# EasyEDA Pro project 第十五届蓝桥杯EDA赛项模拟试题二（嘉立创EDA提供）.eprj, board PCB-PockerMultimater1
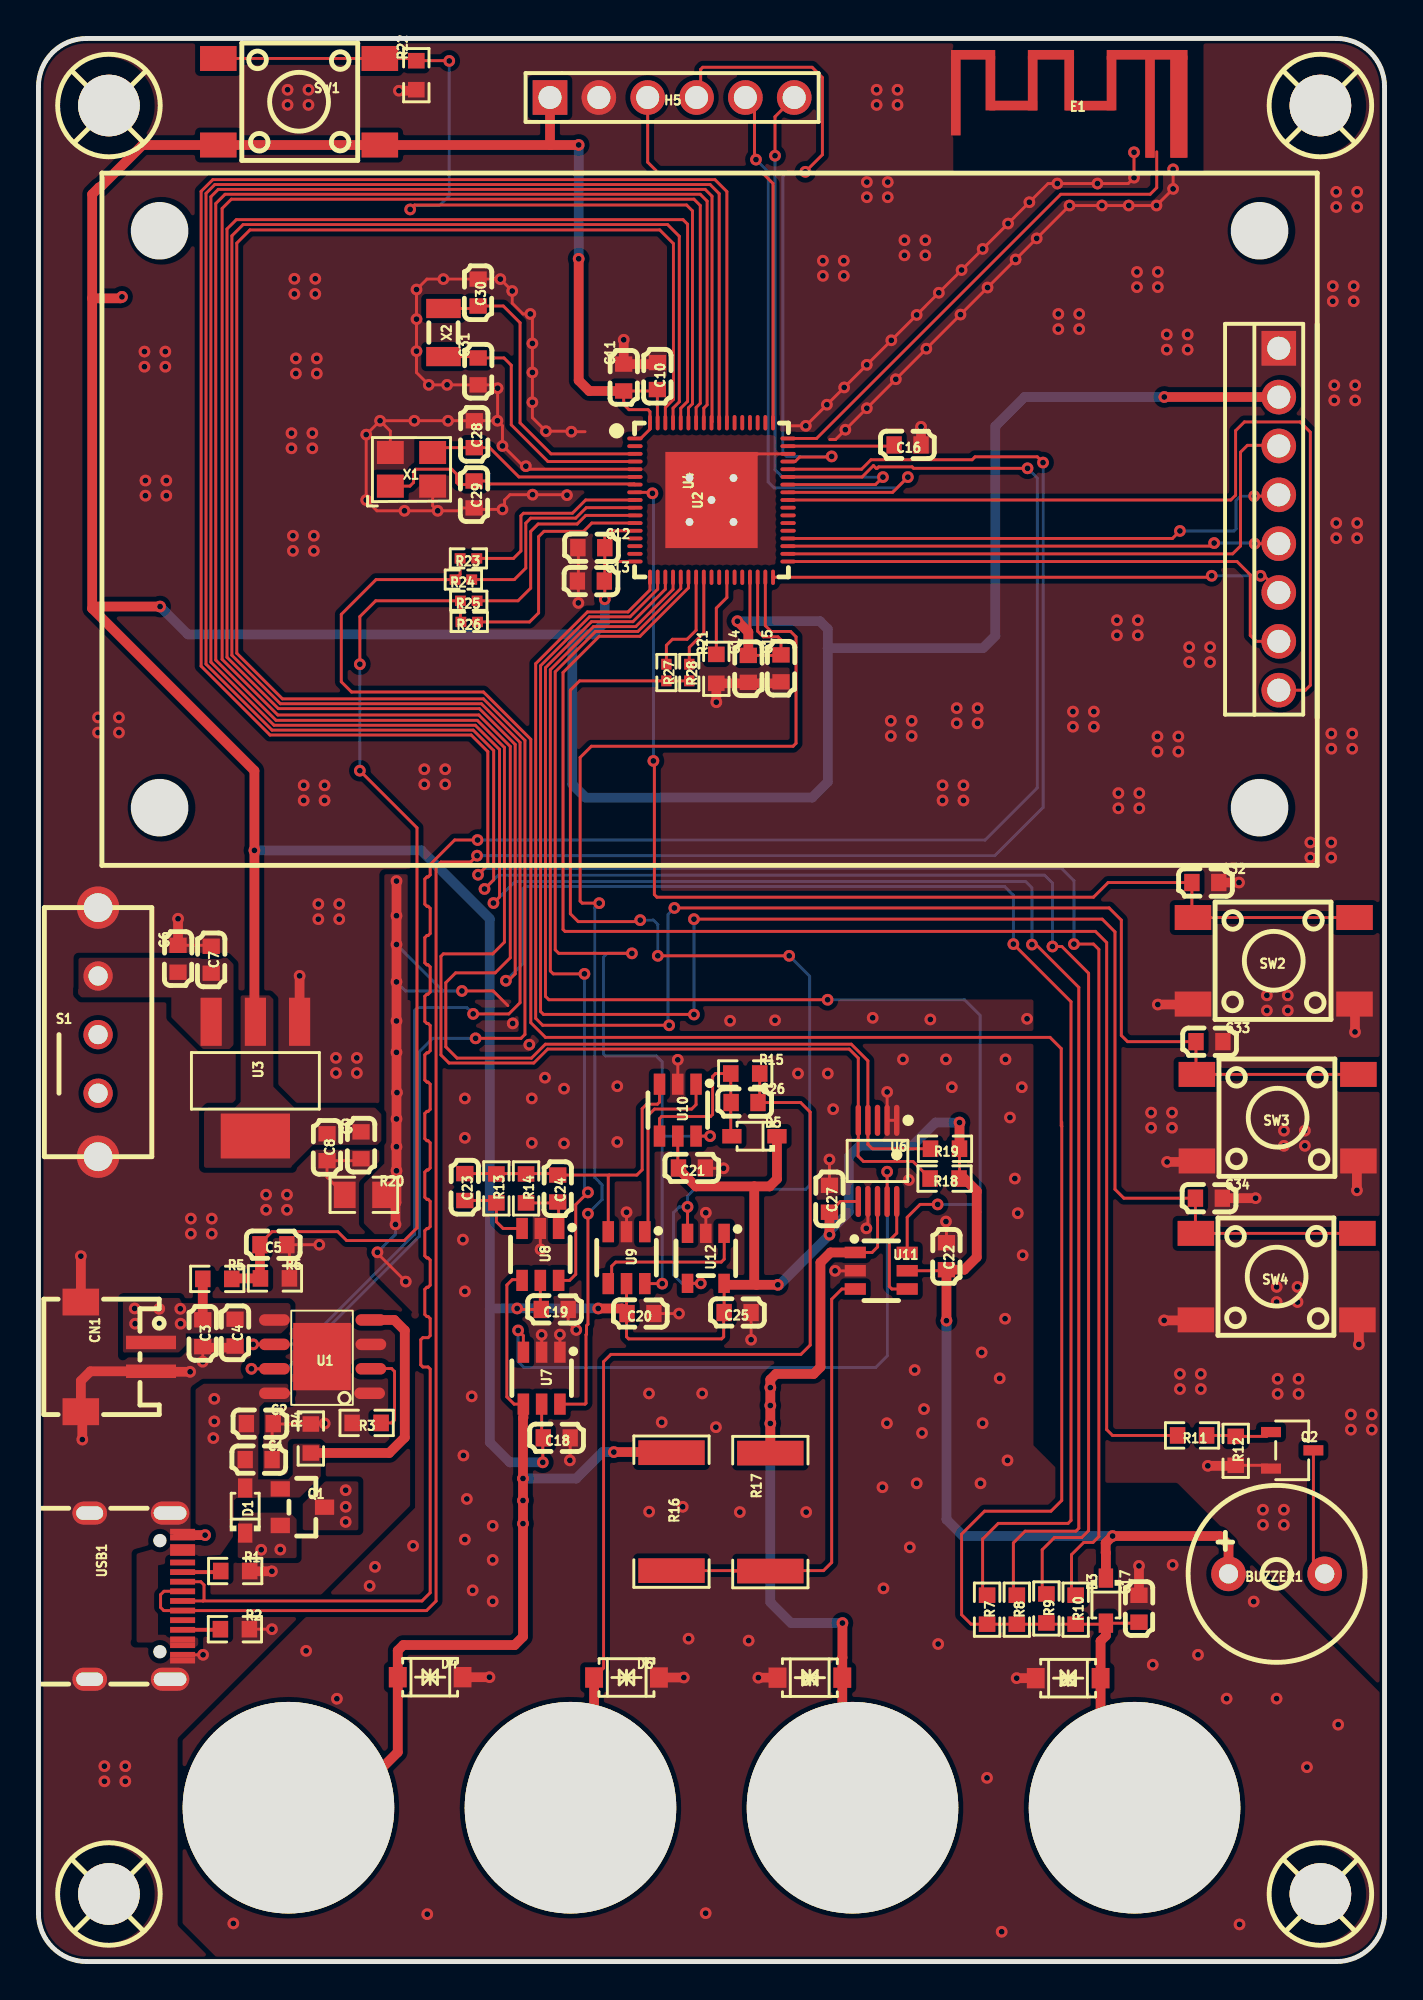
[diagram p1: board, top side]
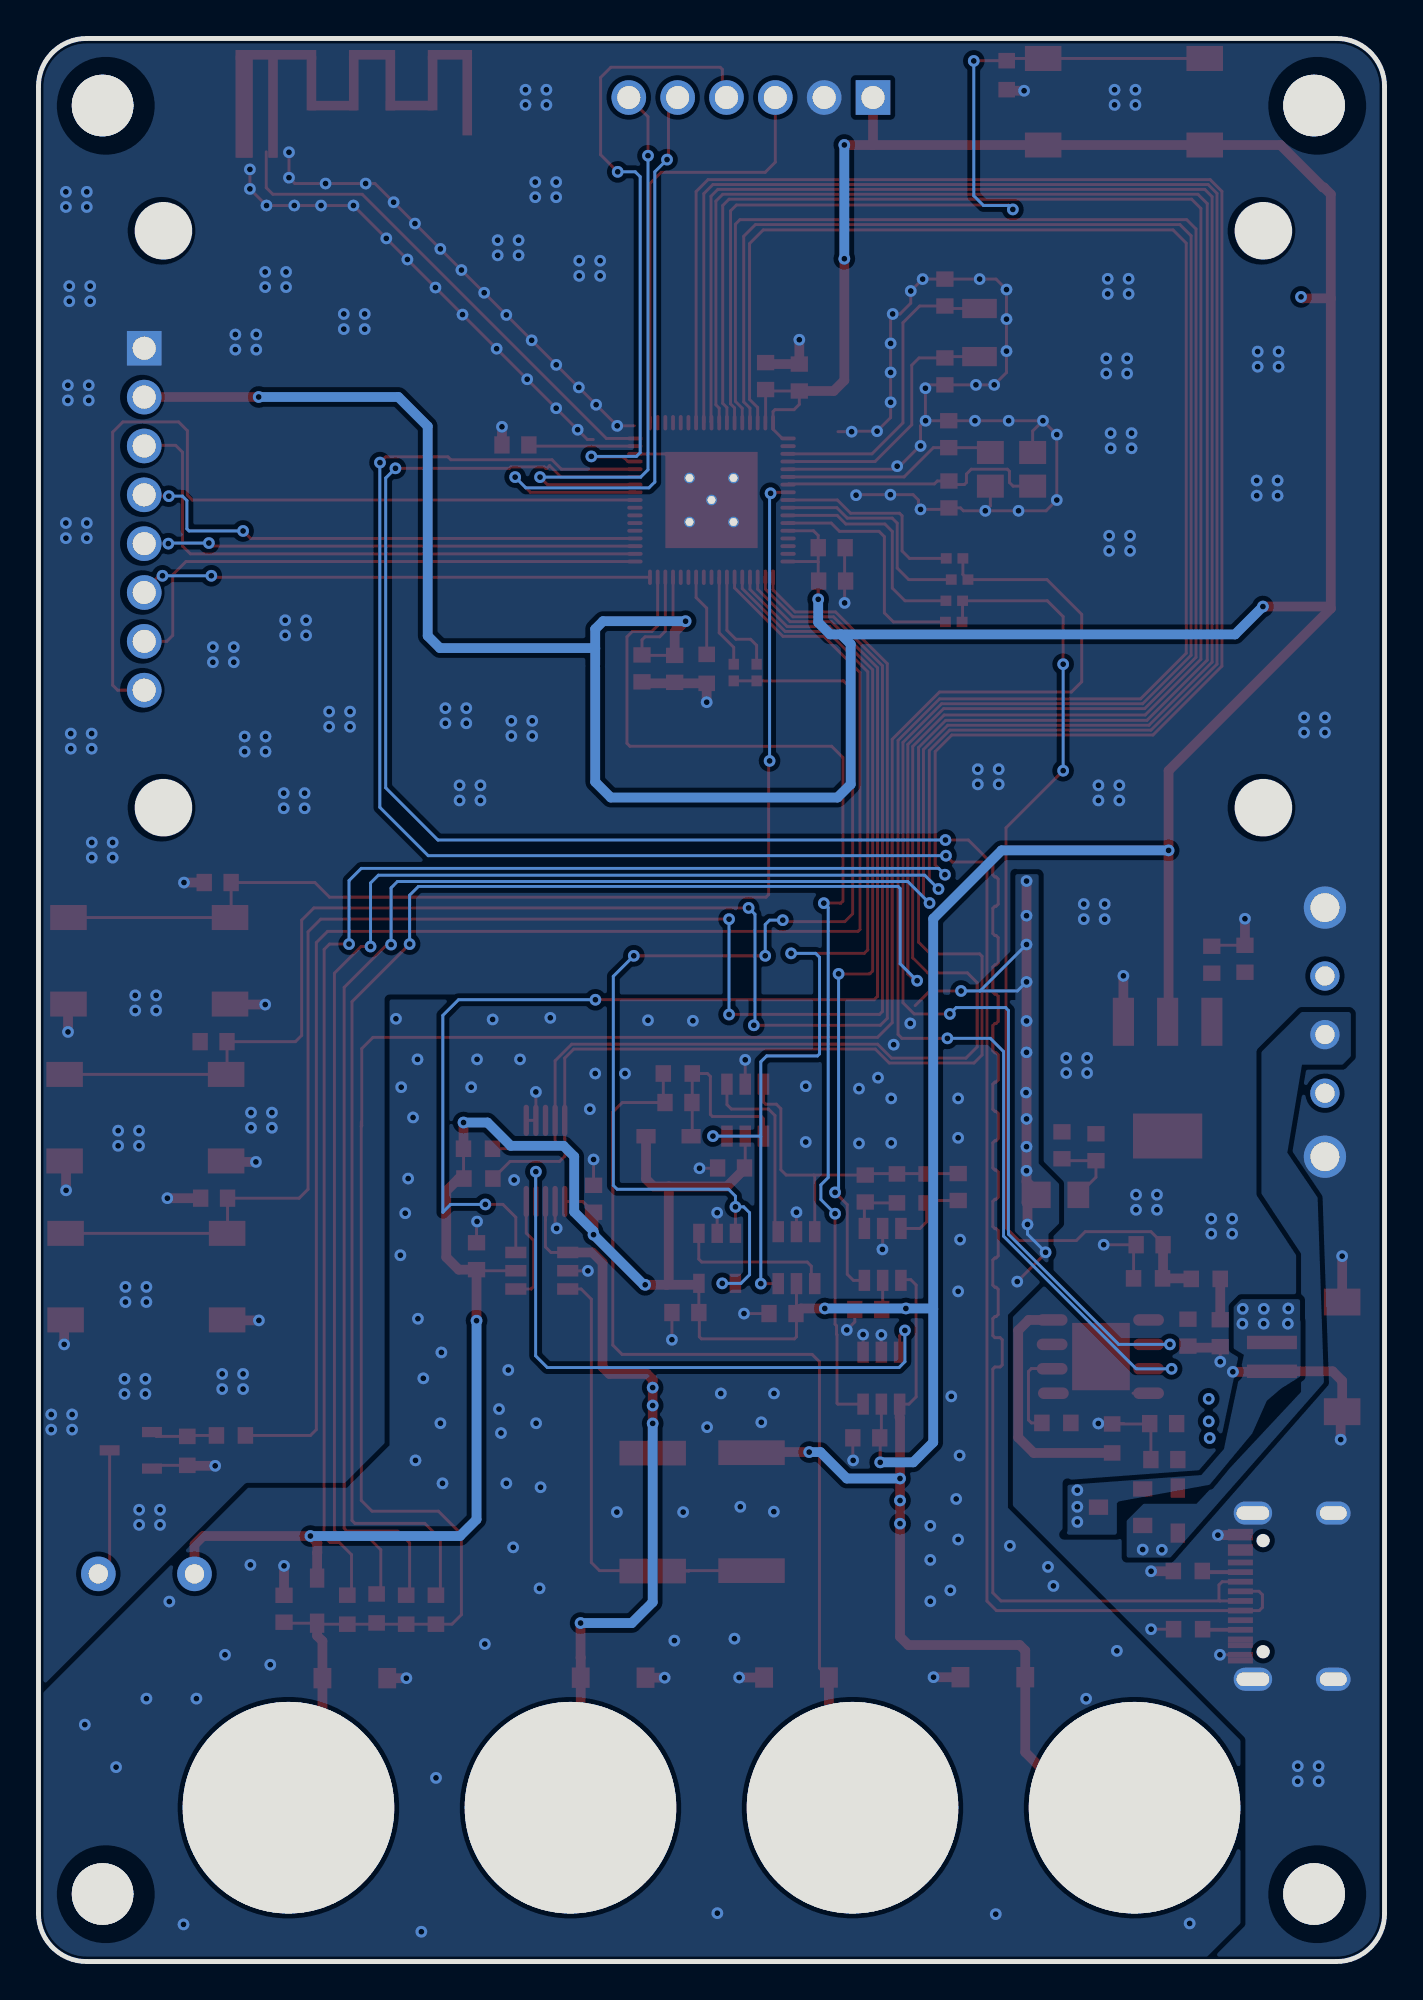
[diagram p2: board, bottom side, seen from below]

Outline 70 x 100 mm; copper layers: Top Layer, Bottom Layer. Coordinates in mm from the lower left corner of the outline.
Outline path: 0,97.5 0,2.5 arc(0.73,0.73) 2.5,0 67.5,0 arc(69.27,0.73) 70,2.5 70,97.5 arc(69.27,99.27) 67.5,100 2.5,100 arc(0.73,99.27) 0,97.5
Stack: Top Layer 0.035mm / Dielectric1 1.51mm FR4 er 4.5 / Bottom Layer 0.035mm

## Design rules (mm)
net USB1DP: DP1
net USB1DM: DP1
template: 自定义配置
spacing copperThickness1oz (default): track to track 0.102, other pairs 0.152 to 0.3
spacing copperThickness2oz: track to track 0.203, other pairs 0.152 to 0.3
spacing ANT: track to track 0.152, other pairs 0.152 to 0.152
track width copperThickness1oz (default): min 0.152, default 0.152, max 2.54
track width copperThickness2oz: min 0.203, default 0.254, max 2.54
differential pair differentialPair (default): width min 0.152, default 0.152, max 2.54; gap min 0.152, default 0.152
via viaSize (default): diameter min 0.559, default 0.559, max 10; hole min 0.254, default 0.254, max 6.299

## Placement (name value [footprint] x y rotation side)
BUZZER1  3kHz  [BUZ-TH_BD9.0-P5.00-D0.6-FD]  64.39 20.16 0 top
C1  10uF  [C0603]  11.45 26.1 180 top
C2  100nF  [C0603]  11.51 27.97 180 top
C3  10uF  [C0603]  8.54 32.67 90 top
C4  100nF  [C0603]  10.22 32.7 90 top
C5  100nF  [C0603]  12.22 37.27 0 top
C6  10uF  [C0603]  7.26 52.14 270 top
C7  100nF  [C0603]  8.98 52.09 90 top
C8  10uF  [C0603]  15.01 42.34 90 top
C9  100nF  [C0603]  16.77 42.44 270 top
C10  100nF  [C0603]  32.19 82.44 90 top
C11  100nF  [C0603]  30.43 82.37 270 top
C12  100nF  [C0603]  28.75 73.52 180 top
C13  100nF  [C0603]  28.73 71.79 180 top
C14  100nF  [C0603]  36.91 67.22 270 top
C15  100nF  [C0603]  38.61 67.24 270 top
C16  1uF  [C0603]  45.2 78.86 0 top
C17  100nF  [C0603]  57.23 18.35 270 top
C18  100nF  [C0603]  26.95 27.23 0 top
C19  100nF  [C0603]  26.85 33.91 0 top
C20  100nF  [C0603]  31.31 33.69 0 top
C21  100nF  [C0603]  33.98 41.27 0 top
C22  100nF  [C0603]  47.22 36.68 90 top
C23  100nF  [C0603]  22.17 40.27 90 top
C24  100nF  [C0603]  27 40.2 90 top
C25  100nF  [C0603]  36.36 33.75 0 top
C26  100nF  [C0603]  36.72 44.67 180 top
C27  100nF  [C0603]  41.13 39.66 90 top
C28  12pF  [C0603]  22.66 79.42 90 top
C29  12pF  [C0603]  22.65 76.29 90 top
C30  12pF  [C0603]  22.86 86.79 90 top
C31  12pF  [C0603]  22.86 82.69 270 top
C32  100nF  [C0603]  60.68 56.11 180 top
C33  100nF  [C0603]  60.89 47.83 180 top
C34  100nF  [C0603]  60.87 39.69 180 top
CN1  1.5K-BH-2PWB  [CONN-SMD_2P-P1.50_HDGC_1.5K-BH-2PWB]  4.03 31.44 270 top
D1  1N5819WS  [SOD-323_L1.8-W1.3-LS2.5-RD]  10.75 23.45 90 top
D2  SJD12C40L01  [SOD-123_L2.8-W1.8-LS3.7-BI]  53.55 14.74 0 top
D3  1N4148  [SOD-323_L1.8-W1.3-LS2.5-RD]  55.51 18.77 270 top
D4  SJD12C40L01  [SOD-123_L2.8-W1.8-LS3.7-BI]  20.37 14.79 180 top
D5  1N4148  [SOD-323_L1.8-W1.3-LS2.5-RD]  37.23 42.92 180 top
D6  SJD12C40L01  [SOD-123_L2.8-W1.8-LS3.7-BI]  30.58 14.77 180 top
D7  SJD12C40L01  [SOD-123_L2.8-W1.8-LS3.7-BI]  40.12 14.76 0 top
E1  d62bb7b376ef4f1495932ffa50be4b9b  [ANT-F-1-2.4G-1.6]  58.15 94.1 0 top
H1  -  [M3]  3.5 96.5 0 top
H2  -  [M3]  66.5 96.5 0 top
H3  -  [M3]  3.5 3.5 0 top
H4  -  [M3]  66.5 3.5 0 top
H5  2.54-1x6P直针  [HDR-TH_6P-P2.54-V-M-1]  32.95 96.93 0 top
J1  -  [香蕉头-4mm-24.302.*]  13 8 0 top
J2  -  [香蕉头-4mm-24.302.*]  27.67 8 0 top
J3  -  [香蕉头-4mm-24.302.*]  42.33 8 0 top
J4  -  [香蕉头-4mm-24.302.*]  57 8 0 top
Q1  AO3401A  [SOT-23_L2.9-W1.3-P1.90-LS2.4-BR]  13.73 23.63 180 top
Q2  S8050  [SOT-23-3_L3.0-W1.7-P0.95-LS2.9-BR]  65.2 26.58 180 top
R1  5.1kΩ  [R0603]  10.23 20.31 180 top
R2  5.1kΩ  [R0603]  10.22 17.28 180 top
R3  10kΩ  [R0603]  17.07 28.01 0 top
R4  10kΩ  [R0603]  14.17 27.2 270 top
R5  10kΩ  [R0603]  9.3 35.5 180 top
R6  10kΩ  [R0603]  12.3 35.52 180 top
R7  1kΩ  [R0603]  49.33 18.3 90 top
R8  10kΩ  [R0603]  50.88 18.3 90 top
R9  100kΩ  [R0603]  52.42 18.36 90 top
R10  1MΩ  [R0603]  53.94 18.3 90 top
R11  10kΩ  [R0603]  59.99 27.36 0 top
R12  10kΩ  [R0603]  62.26 26.56 90 top
R13  100kΩ  [R0603]  23.81 40.2 90 top
R14  1MΩ  [R0603]  25.36 40.2 90 top
R15  1MΩ  [R0603]  36.75 46.18 180 top
R16  10mΩ  [R2512]  32.92 23.39 90 top
R17  80mΩ  [R2512]  38.06 23.37 270 top
R18  4.7kΩ  [R0603]  47.12 40.72 0 top
R19  4.7kΩ  [R0603]  47.14 42.27 0 top
R20  0Ω  [R0805]  16.92 39.87 180 top
R21  10kΩ  [R0603]  35.25 67.22 270 top
R22  10kΩ  [R0603]  19.65 98.09 270 top
R23  0Ω  [R0402]  22.36 72.96 0 top
R24  0Ω  [R0402]  22.1 71.86 0 top
R25  0Ω  [R0402]  22.38 70.76 0 top
R26  0Ω  [R0402]  22.4 69.66 0 top
R27  0Ω  [R0402]  32.65 67.03 90 top
R28  0Ω  [R0402]  33.84 67.03 90 top
S1  SK-12E12-G5  [SW-TH_SK-12E12-G5]  3.1 48.33 180 top
SW1  TS-1002S-07026C  [KEY-SMD_4P-L6.0-W6.0-P4.50-LS9.0]  13.55 96.71 180 top
SW2  TS-1002S-07026C  [KEY-SMD_4P-L6.0-W6.0-P4.50-LS9.0]  64.24 52.04 0 top
SW3  TS-1002S-07026C  [KEY-SMD_4P-L6.0-W6.0-P4.50-LS9.0]  64.44 43.88 0 top
SW4  TS-1002S-07026C  [KEY-SMD_4P-L6.0-W6.0-P4.50-LS9.0]  64.39 35.61 0 top
U1  TP4056X-42-ESOP8  [TP4056-SOP8]  14.75 31.46 0 top
U2  -  [2.0寸TFT屏幕模块-8Pin]  35 75 270 top
U3  AMS1117-3.3  [SOT-223-3_L6.5-W3.4-P2.30-LS7.0-BR]  11.28 45.9 90 top
U4  7693da239a7c4f18baa0651e8e27e4a9  [QFN68(8x8)]  35 76 270 top
U6  INA226AIDGSR  [MSOP-10_L3.0-W3.0-P0.50-LS5.0-BL]  43.63 41.63 180 top
U7  SN74LVC1G3157DBVR  [SOT-23-6_L2.9-W1.6-P0.95-LS2.8-BR]  26.17 30.33 90 top
U8  SN74LVC1G3157DBVR  [SOT-23-6_L2.9-W1.6-P0.95-LS2.8-BR]  26.1 36.77 90 top
U9  SN74LVC1G3157DBVR  [SOT-23-6_L2.9-W1.6-P0.95-LS2.8-BR]  30.58 36.6 90 top
U10  SN74LVC1G3157DBVR  [SOT-23-6_L2.9-W1.6-P0.95-LS2.8-BR]  33.25 44.27 90 top
U11  SN74LVC1G3157DBVR  [SOT-23-6_L2.9-W1.6-P0.95-LS2.8-BR]  43.83 35.92 180 top
U12  LMV321IDBVR  [SOT-23-5_L3.0-W1.7-P0.95-LS2.8-BR]  34.7 36.57 90 top
USB1  KH-TYPE-C-16P  [USB-C-SMD_KH-TYPE-C-16P]  5.08 19 270 top
X1  32MHz  [OSC-SMD_4P-L3.2-W2.5-BL]  19.4 77.59 0 top
X2  32.768kHz  [FC-135R_L3.2-W1.5]  21.06 84.71 90 top

## Footprints (pads in the part's own frame, mm; a bottom-side part is the same pattern mirrored in y, then rotated)
2.0寸TFT屏幕模块-8Pin
  rect 1.8x1.8 hole 1.2: 1(-8.89,29.5)
  round 1.8 hole 1.2: 2(-6.35,29.5) 3(-3.81,29.5) 4(-1.27,29.5) 5(1.27,29.5) 6(3.81,29.5) 7(6.35,29.5) 8(8.89,29.5)
ANT-F-1-2.4G-1.6
  rect 0.8x0.6 smd: 0(1.143,0)
  rect 0.4x0.6 smd: 1(-0.34,0)
BUZ-TH_BD9.0-P5.00-D0.6-FD
  round 1.8 hole 1: 1(-2.5,0) 2(2.5,0)
C0603
  rect 0.8x0.9 smd: 1(-0.7,0) 2(0.7,0)
CONN-SMD_2P-P1.50_HDGC_1.5K-BH-2PWB
  rect 0.7x2.6 smd: 1(-0.75,1.825) 2(0.75,1.825)
  rect 1.4x1.9 smd: 3(2.85,-1.825) 4(-2.85,-1.825)
FC-135R_L3.2-W1.5
  rect 1x1.8 smd: 1(-1.25,0) 2(1.25,0)
HDR-TH_6P-P2.54-V-M-1
  rect 1.8x1.8 hole 1.2: 1(-6.35,0)
  round 1.8 hole 1.2: 2(-3.81,0) 3(-1.27,0) 4(1.27,0) 5(3.81,0) 6(6.35,0)
KEY-SMD_4P-L6.0-W6.0-P4.50-LS9.0
  rect 1.9x1.3 smd: 1(-4.2,2.25) 2(4.2,2.25) 3(-4.2,-2.25) 4(4.2,-2.25)
M3
  round 3.2 hole 3.2: 0(0.165,0.013)
MSOP-10_L3.0-W3.0-P0.50-LS5.0-BL
  oval 0.28x1.62 smd: 1(-1,-2.11) 2(-0.5,-2.11) 3(0,-2.11) 4(0.5,-2.11) 5(1,-2.11) 6(1,2.11) 7(0.5,2.11) 8(0,2.11) 9(-0.5,2.11) 10(-1,2.11)
OSC-SMD_4P-L3.2-W2.5-BL
  rect 1.4x1.2 smd: 1(-1.1,-0.875) 2(1.1,-0.875) 3(1.1,0.875) 4(-1.1,0.875)
QFN68(8x8)
  round 0.559 hole 0.406: 0(-1.143,1.143) 0(-1.143,-1.143) 0(0,0) 0(1.143,1.143) 0(1.143,-1.143)
  rect 5x4.8 smd: 0(0,0)
  oval 0.2x0.8 smd: 1(-3.2,-3.982) 2(-2.8,-3.982) 3(-2.4,-3.982) 4(-2,-3.982) 5(-1.6,-3.982) 6(-1.2,-3.982) 7(-0.8,-3.982) 8(-0.4,-3.982) 9(0,-3.982) 10(0.4,-3.982) 11(0.8,-3.982) 12(1.2,-3.982) 13(1.6,-3.982) 14(2,-3.982) 15(2.4,-3.982) 16(2.8,-3.982) 17(3.2,-3.982) 35(3.2,3.982) 36(2.8,3.982) 37(2.4,3.982) 38(2,3.982) 39(1.6,3.982) 40(1.2,3.982) 41(0.8,3.982) 42(0.4,3.982) 43(0,3.982) 44(-0.4,3.982) 45(-0.8,3.982) 46(-1.2,3.982) 47(-1.6,3.982) 48(-2,3.982) 49(-2.4,3.982) 50(-2.8,3.982) 51(-3.2,3.982)
  oval 0.8x0.2 smd: 18(4.018,-3.2) 19(4.018,-2.8) 20(4.018,-2.4) 21(4.018,-2) 22(4.018,-1.6) 23(4.018,-1.2) 24(4.018,-0.8) 25(4.018,-0.4) 26(4.018,0) 27(4.018,0.4) 28(4.018,0.8) 29(4.018,1.2) 30(4.018,1.6) 31(4.018,2) 32(4.018,2.4) 33(4.018,2.8) 34(4.018,3.2) 52(-4.018,3.2) 53(-4.018,2.8) 54(-4.018,2.4) 55(-4.018,2) 56(-4.018,1.6) 57(-4.018,1.2) 58(-4.018,0.8) 59(-4.018,0.4) 60(-4.018,0) 61(-4.018,-0.4) 62(-4.018,-0.8) 63(-4.018,-1.2) 64(-4.018,-1.6) 65(-4.018,-2) 66(-4.018,-2.4) 67(-4.018,-2.8) 68(-4.018,-3.2)
R0402
  rect 0.566x0.54 smd: 1(-0.433,0) 2(0.433,0)
R0603
  rect 0.806x0.864 smd: 1(-0.753,0) 2(0.753,0)
R0805
  rect 1.133x1.377 smd: 1(-1,0) 2(1,0)
R2512
  rect 1.282x3.456 smd: 1(-3.067,0) 2(3.067,0)
SOD-123_L2.8-W1.8-LS3.7-BI
  rect 0.93x1.06 smd: 1(1.685,0) 2(-1.685,0)
SOD-323_L1.8-W1.3-LS2.5-RD
  rect 1x0.75 smd: 1(-1.173,0) 2(1.173,0)
SOT-23-3_L3.0-W1.7-P0.95-LS2.9-BR
  rect 1.038x0.532 smd: 1(1.101,-0.95) 2(1.101,0.95) 3(-1.101,0)
SOT-23-5_L3.0-W1.7-P0.95-LS2.8-BR
  rect 1x0.6 smd: 1(1.3,-0.95) 2(1.3,0) 3(1.3,0.95) 4(-1.3,0.95) 5(-1.3,-0.95)
SOT-23-6_L2.9-W1.6-P0.95-LS2.8-BR
  rect 1.1x0.6 smd: 1(1.35,-0.95) 2(1.35,0) 3(1.35,0.95) 4(-1.35,0.95) 5(-1.35,0) 6(-1.35,-0.95)
SOT-23_L2.9-W1.3-P1.90-LS2.4-BR
  rect 1x0.8 smd: 1(1.15,-0.95) 2(1.15,0.95) 3(-1.15,0)
SOT-223-3_L6.5-W3.4-P2.30-LS7.0-BR
  rect 2.5x1.1 smd: 1(2.97,-2.3) 2(2.97,0) 3(2.97,2.3)
  rect 2.34x3.6 smd: 4(-2.97,0)
SW-TH_SK-12E12-G5
  round 1.524 hole 1: 1(0,3.175) 2(0,0.127) 3(0,-2.921)
  round 2.2 hole 1.5: 4(0,-6.477) 5(0,6.477)
TP4056-SOP8
  oval 1.6x0.6 smd: 1(2.475,-1.905) 2(2.54,-0.635) 3(2.54,0.635) 4(2.54,1.905) 5(-2.475,1.905) 6(-2.475,0.635) 7(-2.475,-0.635) 8(-2.475,-1.905)
  rect 3x3.5 smd: 9(0,0)
USB-C-SMD_KH-TYPE-C-16P
  oval 1.2x2 hole 0.7x1.7: 1(-4.32,1.765) 2(4.32,1.765)
  oval 1.2x1.8 hole 0.7x1.4: 3(-4.32,-2.415) 4(4.32,-2.415)
  rect 0.3x1.3 smd: A1(-3.35,2.415) A4(-2.55,2.415) A5(-1.25,2.415) A6(-0.25,2.415) A7(0.25,2.415) A8(1.25,2.415) A9(2.55,2.415) A12(3.35,2.415) B1(3.05,2.415) B4(2.25,2.415) B5(1.75,2.415) B6(0.75,2.415) B7(-0.75,2.415) B8(-1.75,2.415) B9(-2.25,2.415) B12(-3.05,2.415)
香蕉头-4mm-24.302.*
  round 11 hole 12.2x6.1: 1(0,0)

## Nets
As in the schematic.

Pads without a net: E1 0; H1 0; H2 0; H3 0; H4 0; S1 1; U4 2 14 15 16 26 27 29 30 39 40 41 42 53 54 55 56 57; U6 3; USB1 A8 B8

## Via types
v1: diameter 0.61, hole 0.305, Top Layer to Bottom Layer, 469 vias

## Routing (per net, layer and track width the routed paths; a pad name or vN(x,y) marks a point on that pad's centre or on a via; arc(x,y) is an arc through that point)
3V3: length 364.3
  Top Layer w0.152: 29.45,72.78 C12.1 29.45,74.16 29.7,74.4 U4.13 ; 29.45,72.78 v1(29.45,70.84) ; 29.45,72.78 29.47,72.8 U4.17 ; U4.32 37.4,69.18 37.69,68.89 38.46,68.89 38.61,68.73 C15.1 38.59,67.92 C14.1 37,68 U4.31 ; C20.1 30.58,33.67 30.58,32.49 30.69,32.38 35.53,32.38 35.63,32.49 35.63,33.72 C25.1 35.66,35.26 ; 30.58,33.85 U9.5 ; R19.2 47.9,40.74 R18.2 ; C22.1 47.16,35.92 U11.5 ; U4.67 32.19,80.03 C10.1 32.11,81.67 C11.2 30.43,80.97 30.71,80.7 31.7,80.7 31.8,80.59 U4.68 31.8,79.68 31.32,79.2 U4.1 ; 26.17,33.6 26.1,33.68 26.1,33.91 ; C19.1 26.1,33.91 ; 26.1,33.91 24.94,33.91 v1(24.89,33.96) ; 26.1,33.91 U8.5 ; U7.5 26.17,27.32 C18.1 26.23,27.21 v1(26.23,25.96) ; U6.6 41.69,39.52 C27.1 ; U10.5 33.25,41.3
  Top Layer w0.508: 2.79,86.49 2.79,91.9 3.15,92.26 3.21,92.26 5.41,94.46 SW1.2 SW1.1 26.63,94.46 ; 2.79,86.49 2.79,70.36 ; 2.79,86.49 4.27,86.49 v1(4.34,86.56) ; v1(36.35,69.7) 36.91,69.13 C14.1 ; BUZZER1.1 61.89,21.68 61.44,22.13 v1(55.86,22.13) 55.5,21.77 55.5,21.26 55.51,21.25 D3.1 ; 37.34,35.19 37.22,35.3 37.22,40.31 ; 37.34,35.19 35.73,35.19 U12.5 ; 37.34,35.19 v1(38.45,35.19) ; 64.6,81.35 64.59,81.36 v1(58.55,81.36) ; 37.22,40.31 38.02,40.31 38.41,40.69 D5.1 ; 37.22,40.31 34.19,40.31 33.28,41.22 C21.1 ; v1(28.09,88.54) 28.09,82.22 28.64,81.67 C11.2 ; 2.79,70.36 2.9,70.46 v1(6.32,70.46) ; 2.79,70.36 11.23,61.92 v1(11.23,57.78) 11.23,48.92 U3.2 ; v1(28.09,94.46) 28.09,94.46 26.63,94.46 ; 47.9,43.64 v1(47.9,43.63) R19.2 ; H5.1 26.6,94.49 26.63,94.46 ; C20.1 30.34,33.96 v1(29.11,33.96) ; v1(47.22,33.33) C22.1 48.14,35.98 48.79,36.63 48.79,40.07 48.14,40.72 R18.2 ; C27.1 v1(41.13,37.8)
  Bottom Layer w0.508: v1(29.11,33.96) v1(24.89,33.96) 23.5,33.96 23.47,33.93 ; 23.47,33.93 23.47,54.23 19.92,57.78 v1(11.23,57.78) ; 23.47,33.93 23.47,27 24.51,25.96 v1(26.23,25.96) ; v1(29.45,70.84) 29.45,69.63 28.83,69.01 28.27,69.01 ; v1(58.55,81.36) 51.28,81.36 49.76,79.83 49.76,68.94 49.12,68.3 41.06,68.3 41.05,68.29 ; 28.27,69.01 7.77,69.01 v1(6.32,70.46) ; 28.27,69.01 27.76,68.5 27.76,61.21 28.45,60.53 40.23,60.53 41.05,61.34 41.05,67.28 ; 41.05,68.29 41.05,67.44 ; 41.05,68.29 41.05,69.29 40.64,69.7 v1(36.35,69.7) ; v1(47.22,33.33) 47.22,22.99 48.08,22.13 v1(55.86,22.13) ; v1(47.9,43.63) 46.65,43.63 45.44,42.42 42.7,42.42 42.14,41.86 42.14,38.98 41.13,37.97 v1(41.13,37.8) 38.53,35.19 v1(38.45,35.19) ; v1(28.09,88.54) v1(28.09,94.46)
+5V:
  vias: v1(11.58,21.41) v1(12.58,21.42)
AGND: length 58.9
  Top Layer w0.152: C18.2 27.65,26.08 v1(27.63,26.06) ; v1(43.05,38.13) 43.13,38.2 U6.7 ; U10.2 v1(33.25,46.89) ; v1(41.43,35.92) 42.47,35.92 U11.2 ; C27.2 v1(41.13,41.71) ; v1(27.97,32.84) 27.55,33.26 C19.2 ; U12.2 v1(34.7,38.94) ; v1(26.11,37.03) 26.1,37.04 U8.2 ; v1(22.02,50.47) 23.65,50.47 24.41,49.71 ; C25.2 v1(37.06,32.33) ; v1(19.1,35.36) 17.63,36.83 v1(17.63,36.88) ; U7.1 v1(27.12,32.6) ; 33.32,33.68 v1(33.31,33.69) 32.01,33.69 ; C22.2 47.22,38.46 v1(47.19,38.48) ; U6.1 U6.2 v1(44.13,45.22) ; U9.2 v1(30.58,38.96) ; U7.2 v1(26.17,32.59) ; v1(35.62,41.25) 34.7,41.25 C21.2
  Top Layer w0.508: 18.59,39.45 18.57,39.42 v1(18.57,38.33) ; 18.59,39.45 18.62,39.47 18.62,40.56 ; 18.59,39.45 18.17,39.87 R20.1 18.62,40.56 ; 32.26,14.77 v1(33.56,14.77) ; 18.62,40.56 v1(18.62,41.12) v1(18.62,42.37) v1(18.62,43.81) v1(18.62,47.28) v1(18.62,48.91) v1(18.62,50.94) v1(18.62,52.89) v1(18.62,54.38) v1(18.62,56.19) ; D7.2 v1(37.44,14.76) ; C17.1 v1(57.23,20.57) ; D2.2 v1(50.87,14.74) ; D4.2 v1(23.45,14.79)